# EAGLE schematic Resistor_Resistor (EAGLE 8.3.0), part 24 of 43
## Parts (continued)
R32958  10K  RESISTOR_0201  [0201]
R32959  10K  RESISTOR_0201  [0201]
R32960  10K  RESISTOR_0201  [0201]
R32961  10K  RESISTOR_0201  [0201]
R32962  10K  RESISTOR_0201  [0201]
R32963  10K  RESISTOR_0201  [0201]
R32964  10K  RESISTOR_0201  [0201]
R32965  10K  RESISTOR_0201  [0201]
R32966  10K  RESISTOR_0201  [0201]
R32967  10K  RESISTOR_0201  [0201]
R32968  10K  RESISTOR_0201  [0201]
R32969  10K  RESISTOR_0201  [0201]
R32970  10K  RESISTOR_0201  [0201]
R32971  10K  RESISTOR_0201  [0201]
R32972  10K  RESISTOR_0201  [0201]
R32973  10K  RESISTOR_0201  [0201]
R32974  10K  RESISTOR_0201  [0201]
R32975  10K  RESISTOR_0201  [0201]
R32976  10K  RESISTOR_0201  [0201]
R32977  10K  RESISTOR_0201  [0201]
R32978  10K  RESISTOR_0201  [0201]
R32979  10K  RESISTOR_0201  [0201]
R32980  10K  RESISTOR_0201  [0201]
R32981  10K  RESISTOR_0201  [0201]
R32982  10K  RESISTOR_0201  [0201]
R32983  10K  RESISTOR_0201  [0201]
R32984  10K  RESISTOR_0201  [0201]
R32985  10K  RESISTOR_0201  [0201]
R32986  10K  RESISTOR_0201  [0201]
R32987  10K  RESISTOR_0201  [0201]
R32988  10K  RESISTOR_0201  [0201]
R32989  10K  RESISTOR_0201  [0201]
R32990  10K  RESISTOR_0201  [0201]
R32991  10K  RESISTOR_0201  [0201]
R32992  10K  RESISTOR_0201  [0201]
R32993  10K  RESISTOR_0201  [0201]
R32994  10K  RESISTOR_0201  [0201]
R32995  10K  RESISTOR_0201  [0201]
R32996  10K  RESISTOR_0201  [0201]
R32997  10K  RESISTOR_0201  [0201]
R32998  10K  RESISTOR_0201  [0201]
R32999  10K  RESISTOR_0201  [0201]
R33000  10K  RESISTOR_0201  [0201]
R33001  10K  RESISTOR_0201  [0201]
R33002  10K  RESISTOR_0201  [0201]
R33003  10K  RESISTOR_0201  [0201]
R33004  10K  RESISTOR_0201  [0201]
R33005  10K  RESISTOR_0201  [0201]
R33006  10K  RESISTOR_0201  [0201]
R33007  10K  RESISTOR_0201  [0201]
R33008  10K  RESISTOR_0201  [0201]
R33009  10K  RESISTOR_0201  [0201]
R33010  10K  RESISTOR_0201  [0201]
R33011  10K  RESISTOR_0201  [0201]
R33012  10K  RESISTOR_0201  [0201]
R33013  10K  RESISTOR_0201  [0201]
R33014  10K  RESISTOR_0201  [0201]
R33015  10K  RESISTOR_0201  [0201]
R33016  10K  RESISTOR_0201  [0201]
R33017  10K  RESISTOR_0201  [0201]
R33018  10K  RESISTOR_0201  [0201]
R33019  10K  RESISTOR_0201  [0201]
R33020  10K  RESISTOR_0201  [0201]
R33021  10K  RESISTOR_0201  [0201]
R33022  10K  RESISTOR_0201  [0201]
R33023  10K  RESISTOR_0201  [0201]
R33024  10K  RESISTOR_0201  [0201]
R33025  10K  RESISTOR_0201  [0201]
R33026  10K  RESISTOR_0201  [0201]
R33027  10K  RESISTOR_0201  [0201]
R33028  10K  RESISTOR_0201  [0201]
R33029  10K  RESISTOR_0201  [0201]
R33030  10K  RESISTOR_0201  [0201]
R33031  10K  RESISTOR_0201  [0201]
R33032  10K  RESISTOR_0201  [0201]
R33033  10K  RESISTOR_0201  [0201]
R33034  10K  RESISTOR_0201  [0201]
R33035  10K  RESISTOR_0201  [0201]
R33036  10K  RESISTOR_0201  [0201]
R33037  10K  RESISTOR_0201  [0201]
R33038  10K  RESISTOR_0201  [0201]
R33039  10K  RESISTOR_0201  [0201]
R33040  10K  RESISTOR_0201  [0201]
R33041  10K  RESISTOR_0201  [0201]
R33042  10K  RESISTOR_0201  [0201]
R33043  10K  RESISTOR_0201  [0201]
R33044  10K  RESISTOR_0201  [0201]
R33045  10K  RESISTOR_0201  [0201]
R33046  10K  RESISTOR_0201  [0201]
R33047  10K  RESISTOR_0201  [0201]
R33048  10K  RESISTOR_0201  [0201]
R33049  10K  RESISTOR_0201  [0201]
R33050  10K  RESISTOR_0201  [0201]
R33051  10K  RESISTOR_0201  [0201]
R33052  10K  RESISTOR_0201  [0201]
R33053  10K  RESISTOR_0201  [0201]
R33054  10K  RESISTOR_0201  [0201]
R33055  10K  RESISTOR_0201  [0201]
R33056  10K  RESISTOR_0201  [0201]
R33057  10K  RESISTOR_0201  [0201]
R33058  10K  RESISTOR_0201  [0201]
R33059  10K  RESISTOR_0201  [0201]
R33060  10K  RESISTOR_0201  [0201]
R33061  10K  RESISTOR_0201  [0201]
R33062  10K  RESISTOR_0201  [0201]
R33063  10K  RESISTOR_0201  [0201]
R33064  10K  RESISTOR_0201  [0201]
R33065  10K  RESISTOR_0201  [0201]
R33066  10K  RESISTOR_0201  [0201]
R33067  10K  RESISTOR_0201  [0201]
R33068  10K  RESISTOR_0201  [0201]
R33069  10K  RESISTOR_0201  [0201]
R33070  10K  RESISTOR_0201  [0201]
R33071  10K  RESISTOR_0201  [0201]
R33072  10K  RESISTOR_0201  [0201]
R33073  10K  RESISTOR_0201  [0201]
R33074  10K  RESISTOR_0201  [0201]
R33075  10K  RESISTOR_0201  [0201]
R33076  10K  RESISTOR_0201  [0201]
R33077  10K  RESISTOR_0201  [0201]
R33078  10K  RESISTOR_0201  [0201]
R33079  10K  RESISTOR_0201  [0201]
R33080  10K  RESISTOR_0201  [0201]
R33081  10K  RESISTOR_0201  [0201]
R33082  10K  RESISTOR_0201  [0201]
R33083  10K  RESISTOR_0201  [0201]
R33084  10K  RESISTOR_0201  [0201]
R33085  10K  RESISTOR_0201  [0201]
R33086  10K  RESISTOR_0201  [0201]
R33087  10K  RESISTOR_0201  [0201]
R33088  10K  RESISTOR_0201  [0201]
R33089  10K  RESISTOR_0201  [0201]
R33090  10K  RESISTOR_0201  [0201]
R33091  10K  RESISTOR_0201  [0201]
R33092  10K  RESISTOR_0201  [0201]
R33093  10K  RESISTOR_0201  [0201]
R33094  10K  RESISTOR_0201  [0201]
R33095  10K  RESISTOR_0201  [0201]
R33096  10K  RESISTOR_0201  [0201]
R33097  10K  RESISTOR_0201  [0201]
R33098  10K  RESISTOR_0201  [0201]
R33099  10K  RESISTOR_0201  [0201]
R33100  10K  RESISTOR_0201  [0201]
R33101  10K  RESISTOR_0201  [0201]
R33102  10K  RESISTOR_0201  [0201]
R33103  10K  RESISTOR_0201  [0201]
R33104  10K  RESISTOR_0201  [0201]
R33105  10K  RESISTOR_0201  [0201]
R33106  10K  RESISTOR_0201  [0201]
R33107  10K  RESISTOR_0201  [0201]
R33108  10K  RESISTOR_0201  [0201]
R33109  10K  RESISTOR_0201  [0201]
R33110  10K  RESISTOR_0201  [0201]
R33111  10K  RESISTOR_0201  [0201]
R33112  10K  RESISTOR_0201  [0201]
R33113  10K  RESISTOR_0201  [0201]
R33114  10K  RESISTOR_0201  [0201]
R33115  10K  RESISTOR_0201  [0201]
R33116  10K  RESISTOR_0201  [0201]
R33117  10K  RESISTOR_0201  [0201]
R33118  10K  RESISTOR_0201  [0201]
R33119  10K  RESISTOR_0201  [0201]
R33120  10K  RESISTOR_0201  [0201]
R33121  10K  RESISTOR_0201  [0201]
R33122  10K  RESISTOR_0201  [0201]
R33123  10K  RESISTOR_0201  [0201]
R33124  10K  RESISTOR_0201  [0201]
R33125  10K  RESISTOR_0201  [0201]
R33126  10K  RESISTOR_0201  [0201]
R33127  10K  RESISTOR_0201  [0201]
R33128  10K  RESISTOR_0201  [0201]
R33129  10K  RESISTOR_0201  [0201]
R33130  10K  RESISTOR_0201  [0201]
R33131  10K  RESISTOR_0201  [0201]
R33132  10K  RESISTOR_0201  [0201]
R33133  10K  RESISTOR_0201  [0201]
R33134  10K  RESISTOR_0201  [0201]
R33135  10K  RESISTOR_0201  [0201]
R33136  10K  RESISTOR_0201  [0201]
R33137  10K  RESISTOR_0201  [0201]
R33138  10K  RESISTOR_0201  [0201]
R33139  10K  RESISTOR_0201  [0201]
R33140  10K  RESISTOR_0201  [0201]
R33141  10K  RESISTOR_0201  [0201]
R33142  10K  RESISTOR_0201  [0201]
R33143  10K  RESISTOR_0201  [0201]
R33144  10K  RESISTOR_0201  [0201]
R33145  10K  RESISTOR_0201  [0201]
R33146  10K  RESISTOR_0201  [0201]
R33147  10K  RESISTOR_0201  [0201]
R33148  10K  RESISTOR_0201  [0201]
R33149  10K  RESISTOR_0201  [0201]
R33150  10K  RESISTOR_0201  [0201]
R33151  10K  RESISTOR_0201  [0201]
R33152  10K  RESISTOR_0201  [0201]
R33153  10K  RESISTOR_0201  [0201]
R33154  10K  RESISTOR_0201  [0201]
R33155  10K  RESISTOR_0201  [0201]
R33156  10K  RESISTOR_0201  [0201]
R33157  10K  RESISTOR_0201  [0201]
R33158  10K  RESISTOR_0201  [0201]
R33159  10K  RESISTOR_0201  [0201]
R33160  10K  RESISTOR_0201  [0201]
R33161  10K  RESISTOR_0201  [0201]
R33162  10K  RESISTOR_0201  [0201]
R33163  10K  RESISTOR_0201  [0201]
R33164  10K  RESISTOR_0201  [0201]
R33165  10K  RESISTOR_0201  [0201]
R33166  10K  RESISTOR_0201  [0201]
R33167  10K  RESISTOR_0201  [0201]
R33168  10K  RESISTOR_0201  [0201]
R33169  10K  RESISTOR_0201  [0201]
R33170  10K  RESISTOR_0201  [0201]
R33171  10K  RESISTOR_0201  [0201]
R33172  10K  RESISTOR_0201  [0201]
R33173  10K  RESISTOR_0201  [0201]
R33174  10K  RESISTOR_0201  [0201]
R33175  10K  RESISTOR_0201  [0201]
R33176  10K  RESISTOR_0201  [0201]
R33177  10K  RESISTOR_0201  [0201]
R33178  10K  RESISTOR_0201  [0201]
R33179  10K  RESISTOR_0201  [0201]
R33180  10K  RESISTOR_0201  [0201]
R33181  10K  RESISTOR_0201  [0201]
R33182  10K  RESISTOR_0201  [0201]
R33183  10K  RESISTOR_0201  [0201]
R33184  10K  RESISTOR_0201  [0201]
R33185  10K  RESISTOR_0201  [0201]
R33186  10K  RESISTOR_0201  [0201]
R33187  10K  RESISTOR_0201  [0201]
R33188  10K  RESISTOR_0201  [0201]
R33189  10K  RESISTOR_0201  [0201]
R33190  10K  RESISTOR_0201  [0201]
R33191  10K  RESISTOR_0201  [0201]
R33192  10K  RESISTOR_0201  [0201]
R33193  10K  RESISTOR_0201  [0201]
R33194  10K  RESISTOR_0201  [0201]
R33195  10K  RESISTOR_0201  [0201]
R33196  10K  RESISTOR_0201  [0201]
R33197  10K  RESISTOR_0201  [0201]
R33198  10K  RESISTOR_0201  [0201]
R33199  10K  RESISTOR_0201  [0201]
R33200  10K  RESISTOR_0201  [0201]
R33201  10K  RESISTOR_0201  [0201]
R33202  10K  RESISTOR_0201  [0201]
R33203  10K  RESISTOR_0201  [0201]
R33204  10K  RESISTOR_0201  [0201]
R33205  10K  RESISTOR_0201  [0201]
R33206  10K  RESISTOR_0201  [0201]
R33207  10K  RESISTOR_0201  [0201]
R33208  10K  RESISTOR_0201  [0201]
R33209  10K  RESISTOR_0201  [0201]
R33210  10K  RESISTOR_0201  [0201]
R33211  10K  RESISTOR_0201  [0201]
R33212  10K  RESISTOR_0201  [0201]
R33213  10K  RESISTOR_0201  [0201]
R33214  10K  RESISTOR_0201  [0201]
R33215  10K  RESISTOR_0201  [0201]
R33216  10K  RESISTOR_0201  [0201]
R33217  10K  RESISTOR_0201  [0201]
R33218  10K  RESISTOR_0201  [0201]
R33219  10K  RESISTOR_0201  [0201]
R33220  10K  RESISTOR_0201  [0201]
R33221  10K  RESISTOR_0201  [0201]
R33222  10K  RESISTOR_0201  [0201]
R33223  10K  RESISTOR_0201  [0201]
R33224  10K  RESISTOR_0201  [0201]
R33225  10K  RESISTOR_0201  [0201]
R33226  10K  RESISTOR_0201  [0201]
R33227  10K  RESISTOR_0201  [0201]
R33228  10K  RESISTOR_0201  [0201]
R33229  10K  RESISTOR_0201  [0201]
R33230  10K  RESISTOR_0201  [0201]
R33231  10K  RESISTOR_0201  [0201]
R33232  10K  RESISTOR_0201  [0201]
R33233  10K  RESISTOR_0201  [0201]
R33234  10K  RESISTOR_0201  [0201]
R33235  10K  RESISTOR_0201  [0201]
R33236  10K  RESISTOR_0201  [0201]
R33237  10K  RESISTOR_0201  [0201]
R33238  10K  RESISTOR_0201  [0201]
R33239  10K  RESISTOR_0201  [0201]
R33240  10K  RESISTOR_0201  [0201]
R33241  10K  RESISTOR_0201  [0201]
R33242  10K  RESISTOR_0201  [0201]
R33243  10K  RESISTOR_0201  [0201]
R33244  10K  RESISTOR_0201  [0201]
R33245  10K  RESISTOR_0201  [0201]
R33246  10K  RESISTOR_0201  [0201]
R33247  10K  RESISTOR_0201  [0201]
R33248  10K  RESISTOR_0201  [0201]
R33249  10K  RESISTOR_0201  [0201]
R33250  10K  RESISTOR_0201  [0201]
R33251  10K  RESISTOR_0201  [0201]
R33252  10K  RESISTOR_0201  [0201]
R33253  10K  RESISTOR_0201  [0201]
R33254  10K  RESISTOR_0201  [0201]
R33255  10K  RESISTOR_0201  [0201]
R33256  10K  RESISTOR_0201  [0201]
R33257  10K  RESISTOR_0201  [0201]
R33258  10K  RESISTOR_0201  [0201]
R33259  10K  RESISTOR_0201  [0201]
R33260  10K  RESISTOR_0201  [0201]
R33261  10K  RESISTOR_0201  [0201]
R33262  10K  RESISTOR_0201  [0201]
R33263  10K  RESISTOR_0201  [0201]
R33264  10K  RESISTOR_0201  [0201]
R33265  10K  RESISTOR_0201  [0201]
R33266  10K  RESISTOR_0201  [0201]
R33267  10K  RESISTOR_0201  [0201]
R33268  10K  RESISTOR_0201  [0201]
R33269  10K  RESISTOR_0201  [0201]
R33270  10K  RESISTOR_0201  [0201]
R33271  10K  RESISTOR_0201  [0201]
R33272  10K  RESISTOR_0201  [0201]
R33273  10K  RESISTOR_0201  [0201]
R33274  10K  RESISTOR_0201  [0201]
R33275  10K  RESISTOR_0201  [0201]
R33276  10K  RESISTOR_0201  [0201]
R33277  10K  RESISTOR_0201  [0201]
R33278  10K  RESISTOR_0201  [0201]
R33279  10K  RESISTOR_0201  [0201]
R33280  10K  RESISTOR_0201  [0201]
R33281  10K  RESISTOR_0201  [0201]
R33282  10K  RESISTOR_0201  [0201]
R33283  10K  RESISTOR_0201  [0201]
R33284  10K  RESISTOR_0201  [0201]
R33285  10K  RESISTOR_0201  [0201]
R33286  10K  RESISTOR_0201  [0201]
R33287  10K  RESISTOR_0201  [0201]
R33288  10K  RESISTOR_0201  [0201]
R33289  10K  RESISTOR_0201  [0201]
R33290  10K  RESISTOR_0201  [0201]
R33291  10K  RESISTOR_0201  [0201]
R33292  10K  RESISTOR_0201  [0201]
R33293  10K  RESISTOR_0201  [0201]
R33294  10K  RESISTOR_0201  [0201]
R33295  10K  RESISTOR_0201  [0201]
R33296  10K  RESISTOR_0201  [0201]
R33297  10K  RESISTOR_0201  [0201]
R33298  10K  RESISTOR_0201  [0201]
R33299  10K  RESISTOR_0201  [0201]
R33300  10K  RESISTOR_0201  [0201]
R33301  10K  RESISTOR_0201  [0201]
R33302  10K  RESISTOR_0201  [0201]
R33303  10K  RESISTOR_0201  [0201]
R33304  10K  RESISTOR_0201  [0201]
R33305  10K  RESISTOR_0201  [0201]
R33306  10K  RESISTOR_0201  [0201]
R33307  10K  RESISTOR_0201  [0201]
R33308  10K  RESISTOR_0201  [0201]
R33309  10K  RESISTOR_0201  [0201]
R33310  10K  RESISTOR_0201  [0201]
R33311  10K  RESISTOR_0201  [0201]
R33312  10K  RESISTOR_0201  [0201]
R33313  10K  RESISTOR_0201  [0201]
R33314  10K  RESISTOR_0201  [0201]
R33315  10K  RESISTOR_0201  [0201]
R33316  10K  RESISTOR_0201  [0201]
R33317  10K  RESISTOR_0201  [0201]
R33318  10K  RESISTOR_0201  [0201]
R33319  10K  RESISTOR_0201  [0201]
R33320  10K  RESISTOR_0201  [0201]
R33321  10K  RESISTOR_0201  [0201]
R33322  10K  RESISTOR_0201  [0201]
R33323  10K  RESISTOR_0201  [0201]
R33324  10K  RESISTOR_0201  [0201]
R33325  10K  RESISTOR_0201  [0201]
R33326  10K  RESISTOR_0201  [0201]
R33327  10K  RESISTOR_0201  [0201]
R33328  10K  RESISTOR_0201  [0201]
R33329  10K  RESISTOR_0201  [0201]
R33330  10K  RESISTOR_0201  [0201]
R33331  10K  RESISTOR_0201  [0201]
R33332  10K  RESISTOR_0201  [0201]
R33333  10K  RESISTOR_0201  [0201]
R33334  10K  RESISTOR_0201  [0201]
R33335  10K  RESISTOR_0201  [0201]
R33336  10K  RESISTOR_0201  [0201]
R33337  10K  RESISTOR_0201  [0201]
R33338  10K  RESISTOR_0201  [0201]
R33339  10K  RESISTOR_0201  [0201]
R33340  10K  RESISTOR_0201  [0201]
R33341  10K  RESISTOR_0201  [0201]
R33342  10K  RESISTOR_0201  [0201]
R33343  10K  RESISTOR_0201  [0201]
R33344  10K  RESISTOR_0201  [0201]
R33345  10K  RESISTOR_0201  [0201]
R33346  10K  RESISTOR_0201  [0201]
R33347  10K  RESISTOR_0201  [0201]
R33348  10K  RESISTOR_0201  [0201]
R33349  10K  RESISTOR_0201  [0201]
R33350  10K  RESISTOR_0201  [0201]
R33351  10K  RESISTOR_0201  [0201]
R33352  10K  RESISTOR_0201  [0201]
R33353  10K  RESISTOR_0201  [0201]
R33354  10K  RESISTOR_0201  [0201]
R33355  10K  RESISTOR_0201  [0201]
R33356  10K  RESISTOR_0201  [0201]
R33357  10K  RESISTOR_0201  [0201]
R33358  10K  RESISTOR_0201  [0201]
R33359  10K  RESISTOR_0201  [0201]
R33360  10K  RESISTOR_0201  [0201]
R33361  10K  RESISTOR_0201  [0201]
R33362  10K  RESISTOR_0201  [0201]
R33363  10K  RESISTOR_0201  [0201]
R33364  10K  RESISTOR_0201  [0201]
R33365  10K  RESISTOR_0201  [0201]
R33366  10K  RESISTOR_0201  [0201]
R33367  10K  RESISTOR_0201  [0201]
R33368  10K  RESISTOR_0201  [0201]
R33369  10K  RESISTOR_0201  [0201]
R33370  10K  RESISTOR_0201  [0201]
R33371  10K  RESISTOR_0201  [0201]
R33372  10K  RESISTOR_0201  [0201]
R33373  10K  RESISTOR_0201  [0201]
R33374  10K  RESISTOR_0201  [0201]
R33375  10K  RESISTOR_0201  [0201]
R33376  10K  RESISTOR_0201  [0201]
R33377  10K  RESISTOR_0201  [0201]
R33378  10K  RESISTOR_0201  [0201]
R33379  10K  RESISTOR_0201  [0201]
R33380  10K  RESISTOR_0201  [0201]
R33381  10K  RESISTOR_0201  [0201]
R33382  10K  RESISTOR_0201  [0201]
R33383  10K  RESISTOR_0201  [0201]
R33384  10K  RESISTOR_0201  [0201]
R33385  10K  RESISTOR_0201  [0201]
R33386  10K  RESISTOR_0201  [0201]
R33387  10K  RESISTOR_0201  [0201]
R33388  10K  RESISTOR_0201  [0201]
R33389  10K  RESISTOR_0201  [0201]
R33390  10K  RESISTOR_0201  [0201]
R33391  10K  RESISTOR_0201  [0201]
R33392  10K  RESISTOR_0201  [0201]
R33393  10K  RESISTOR_0201  [0201]
R33394  10K  RESISTOR_0201  [0201]
R33395  10K  RESISTOR_0201  [0201]
R33396  10K  RESISTOR_0201  [0201]
R33397  10K  RESISTOR_0201  [0201]
R33398  10K  RESISTOR_0201  [0201]
R33399  10K  RESISTOR_0201  [0201]
R33400  10K  RESISTOR_0201  [0201]
R33401  10K  RESISTOR_0201  [0201]
R33402  10K  RESISTOR_0201  [0201]
R33403  10K  RESISTOR_0201  [0201]
R33404  10K  RESISTOR_0201  [0201]
R33405  10K  RESISTOR_0201  [0201]
R33406  10K  RESISTOR_0201  [0201]
R33407  10K  RESISTOR_0201  [0201]
R33408  10K  RESISTOR_0201  [0201]
R33409  10K  RESISTOR_0201  [0201]
R33410  10K  RESISTOR_0201  [0201]
R33411  10K  RESISTOR_0201  [0201]
R33412  10K  RESISTOR_0201  [0201]
R33413  10K  RESISTOR_0201  [0201]
R33414  10K  RESISTOR_0201  [0201]
R33415  10K  RESISTOR_0201  [0201]
R33416  10K  RESISTOR_0201  [0201]
R33417  10K  RESISTOR_0201  [0201]
R33418  10K  RESISTOR_0201  [0201]
R33419  10K  RESISTOR_0201  [0201]
R33420  10K  RESISTOR_0201  [0201]
R33421  10K  RESISTOR_0201  [0201]
R33422  10K  RESISTOR_0201  [0201]
R33423  10K  RESISTOR_0201  [0201]
R33424  10K  RESISTOR_0201  [0201]
R33425  10K  RESISTOR_0201  [0201]
R33426  10K  RESISTOR_0201  [0201]
R33427  10K  RESISTOR_0201  [0201]
R33428  10K  RESISTOR_0201  [0201]
R33429  10K  RESISTOR_0201  [0201]
R33430  10K  RESISTOR_0201  [0201]
R33431  10K  RESISTOR_0201  [0201]
R33432  10K  RESISTOR_0201  [0201]
R33433  10K  RESISTOR_0201  [0201]
R33434  10K  RESISTOR_0201  [0201]
R33435  10K  RESISTOR_0201  [0201]
R33436  10K  RESISTOR_0201  [0201]
R33437  10K  RESISTOR_0201  [0201]
R33438  10K  RESISTOR_0201  [0201]
R33439  10K  RESISTOR_0201  [0201]
R33440  10K  RESISTOR_0201  [0201]
R33441  10K  RESISTOR_0201  [0201]
R33442  10K  RESISTOR_0201  [0201]
R33443  10K  RESISTOR_0201  [0201]
R33444  10K  RESISTOR_0201  [0201]
R33445  10K  RESISTOR_0201  [0201]
R33446  10K  RESISTOR_0201  [0201]
R33447  10K  RESISTOR_0201  [0201]
R33448  10K  RESISTOR_0201  [0201]
R33449  10K  RESISTOR_0201  [0201]
R33450  10K  RESISTOR_0201  [0201]
R33451  10K  RESISTOR_0201  [0201]
R33452  10K  RESISTOR_0201  [0201]
R33453  10K  RESISTOR_0201  [0201]
R33454  10K  RESISTOR_0201  [0201]
R33455  10K  RESISTOR_0201  [0201]
R33456  10K  RESISTOR_0201  [0201]
R33457  10K  RESISTOR_0201  [0201]
R33458  10K  RESISTOR_0201  [0201]
R33459  10K  RESISTOR_0201  [0201]
R33460  10K  RESISTOR_0201  [0201]
R33461  10K  RESISTOR_0201  [0201]
R33462  10K  RESISTOR_0201  [0201]
R33463  10K  RESISTOR_0201  [0201]
R33464  10K  RESISTOR_0201  [0201]
R33465  10K  RESISTOR_0201  [0201]
R33466  10K  RESISTOR_0201  [0201]
R33467  10K  RESISTOR_0201  [0201]
R33468  10K  RESISTOR_0201  [0201]
R33469  10K  RESISTOR_0201  [0201]
R33470  10K  RESISTOR_0201  [0201]
R33471  10K  RESISTOR_0201  [0201]
R33472  10K  RESISTOR_0201  [0201]
R33473  10K  RESISTOR_0201  [0201]
R33474  10K  RESISTOR_0201  [0201]
R33475  10K  RESISTOR_0201  [0201]
R33476  10K  RESISTOR_0201  [0201]
R33477  10K  RESISTOR_0201  [0201]
R33478  10K  RESISTOR_0201  [0201]
R33479  10K  RESISTOR_0201  [0201]
R33480  10K  RESISTOR_0201  [0201]
R33481  10K  RESISTOR_0201  [0201]
R33482  10K  RESISTOR_0201  [0201]
R33483  10K  RESISTOR_0201  [0201]
R33484  10K  RESISTOR_0201  [0201]
R33485  10K  RESISTOR_0201  [0201]
R33486  10K  RESISTOR_0201  [0201]
R33487  10K  RESISTOR_0201  [0201]
R33488  10K  RESISTOR_0201  [0201]
R33489  10K  RESISTOR_0201  [0201]
R33490  10K  RESISTOR_0201  [0201]
R33491  10K  RESISTOR_0201  [0201]
R33492  10K  RESISTOR_0201  [0201]
R33493  10K  RESISTOR_0201  [0201]
R33494  10K  RESISTOR_0201  [0201]
R33495  10K  RESISTOR_0201  [0201]
R33496  10K  RESISTOR_0201  [0201]
R33497  10K  RESISTOR_0201  [0201]
R33498  10K  RESISTOR_0201  [0201]
R33499  10K  RESISTOR_0201  [0201]
R33500  10K  RESISTOR_0201  [0201]
R33501  10K  RESISTOR_0201  [0201]
R33502  10K  RESISTOR_0201  [0201]
R33503  10K  RESISTOR_0201  [0201]
R33504  10K  RESISTOR_0201  [0201]
R33505  10K  RESISTOR_0201  [0201]
R33506  10K  RESISTOR_0201  [0201]
R33507  10K  RESISTOR_0201  [0201]
R33508  10K  RESISTOR_0201  [0201]
R33509  10K  RESISTOR_0201  [0201]
R33510  10K  RESISTOR_0201  [0201]
R33511  10K  RESISTOR_0201  [0201]
R33512  10K  RESISTOR_0201  [0201]
R33513  10K  RESISTOR_0201  [0201]
R33514  10K  RESISTOR_0201  [0201]
R33515  10K  RESISTOR_0201  [0201]
R33516  10K  RESISTOR_0201  [0201]
R33517  10K  RESISTOR_0201  [0201]
R33518  10K  RESISTOR_0201  [0201]
R33519  10K  RESISTOR_0201  [0201]
R33520  10K  RESISTOR_0201  [0201]
R33521  10K  RESISTOR_0201  [0201]
R33522  10K  RESISTOR_0201  [0201]
R33523  10K  RESISTOR_0201  [0201]
R33524  10K  RESISTOR_0201  [0201]
R33525  10K  RESISTOR_0201  [0201]
R33526  10K  RESISTOR_0201  [0201]
R33527  10K  RESISTOR_0201  [0201]
R33528  10K  RESISTOR_0201  [0201]
R33529  10K  RESISTOR_0201  [0201]
R33530  10K  RESISTOR_0201  [0201]
R33531  10K  RESISTOR_0201  [0201]
R33532  10K  RESISTOR_0201  [0201]
R33533  10K  RESISTOR_0201  [0201]
R33534  10K  RESISTOR_0201  [0201]
R33535  10K  RESISTOR_0201  [0201]
R33536  10K  RESISTOR_0201  [0201]
R33537  10K  RESISTOR_0201  [0201]
R33538  10K  RESISTOR_0201  [0201]
R33539  10K  RESISTOR_0201  [0201]
R33540  10K  RESISTOR_0201  [0201]
R33541  10K  RESISTOR_0201  [0201]
R33542  10K  RESISTOR_0201  [0201]
R33543  10K  RESISTOR_0201  [0201]
R33544  10K  RESISTOR_0201  [0201]
R33545  10K  RESISTOR_0201  [0201]
R33546  10K  RESISTOR_0201  [0201]
R33547  10K  RESISTOR_0201  [0201]
R33548  10K  RESISTOR_0201  [0201]
R33549  10K  RESISTOR_0201  [0201]
R33550  10K  RESISTOR_0201  [0201]
R33551  10K  RESISTOR_0201  [0201]
R33552  10K  RESISTOR_0201  [0201]
R33553  10K  RESISTOR_0201  [0201]
R33554  10K  RESISTOR_0201  [0201]
R33555  10K  RESISTOR_0201  [0201]
R33556  10K  RESISTOR_0201  [0201]
R33557  10K  RESISTOR_0201  [0201]
R33558  10K  RESISTOR_0201  [0201]
R33559  10K  RESISTOR_0201  [0201]
R33560  10K  RESISTOR_0201  [0201]
R33561  10K  RESISTOR_0201  [0201]
R33562  10K  RESISTOR_0201  [0201]
R33563  10K  RESISTOR_0201  [0201]
R33564  10K  RESISTOR_0201  [0201]
R33565  10K  RESISTOR_0201  [0201]
R33566  10K  RESISTOR_0201  [0201]
R33567  10K  RESISTOR_0201  [0201]
R33568  10K  RESISTOR_0201  [0201]
R33569  10K  RESISTOR_0201  [0201]
R33570  10K  RESISTOR_0201  [0201]
R33571  10K  RESISTOR_0201  [0201]
R33572  10K  RESISTOR_0201  [0201]
R33573  10K  RESISTOR_0201  [0201]
R33574  10K  RESISTOR_0201  [0201]
R33575  10K  RESISTOR_0201  [0201]
R33576  10K  RESISTOR_0201  [0201]
R33577  10K  RESISTOR_0201  [0201]
R33578  10K  RESISTOR_0201  [0201]
R33579  10K  RESISTOR_0201  [0201]
R33580  10K  RESISTOR_0201  [0201]
R33581  10K  RESISTOR_0201  [0201]
R33582  10K  RESISTOR_0201  [0201]
R33583  10K  RESISTOR_0201  [0201]
R33584  10K  RESISTOR_0201  [0201]
R33585  10K  RESISTOR_0201  [0201]
R33586  10K  RESISTOR_0201  [0201]
R33587  10K  RESISTOR_0201  [0201]
R33588  10K  RESISTOR_0201  [0201]
R33589  10K  RESISTOR_0201  [0201]
R33590  10K  RESISTOR_0201  [0201]
R33591  10K  RESISTOR_0201  [0201]
R33592  10K  RESISTOR_0201  [0201]
R33593  10K  RESISTOR_0201  [0201]
R33594  10K  RESISTOR_0201  [0201]
R33595  10K  RESISTOR_0201  [0201]
R33596  10K  RESISTOR_0201  [0201]
R33597  10K  RESISTOR_0201  [0201]
R33598  10K  RESISTOR_0201  [0201]
R33599  10K  RESISTOR_0201  [0201]
R33600  10K  RESISTOR_0201  [0201]
R33601  10K  RESISTOR_0201  [0201]
R33602  10K  RESISTOR_0201  [0201]
R33603  10K  RESISTOR_0201  [0201]
R33604  10K  RESISTOR_0201  [0201]
R33605  10K  RESISTOR_0201  [0201]
R33606  10K  RESISTOR_0201  [0201]
R33607  10K  RESISTOR_0201  [0201]
R33608  10K  RESISTOR_0201  [0201]
R33609  10K  RESISTOR_0201  [0201]
R33610  10K  RESISTOR_0201  [0201]
R33611  10K  RESISTOR_0201  [0201]
R33612  10K  RESISTOR_0201  [0201]
R33613  10K  RESISTOR_0201  [0201]
R33614  10K  RESISTOR_0201  [0201]
R33615  10K  RESISTOR_0201  [0201]
R33616  10K  RESISTOR_0201  [0201]
R33617  10K  RESISTOR_0201  [0201]
R33618  10K  RESISTOR_0201  [0201]
R33619  10K  RESISTOR_0201  [0201]
R33620  10K  RESISTOR_0201  [0201]
R33621  10K  RESISTOR_0201  [0201]
R33622  10K  RESISTOR_0201  [0201]
R33623  10K  RESISTOR_0201  [0201]
R33624  10K  RESISTOR_0201  [0201]
R33625  10K  RESISTOR_0201  [0201]
R33626  10K  RESISTOR_0201  [0201]
R33627  10K  RESISTOR_0201  [0201]
R33628  10K  RESISTOR_0201  [0201]
R33629  10K  RESISTOR_0201  [0201]
R33630  10K  RESISTOR_0201  [0201]
R33631  10K  RESISTOR_0201  [0201]
R33632  10K  RESISTOR_0201  [0201]
R33633  10K  RESISTOR_0201  [0201]
R33634  10K  RESISTOR_0201  [0201]
R33635  10K  RESISTOR_0201  [0201]
R33636  10K  RESISTOR_0201  [0201]
R33637  10K  RESISTOR_0201  [0201]
R33638  10K  RESISTOR_0201  [0201]
R33639  10K  RESISTOR_0201  [0201]
R33640  10K  RESISTOR_0201  [0201]
R33641  10K  RESISTOR_0201  [0201]
R33642  10K  RESISTOR_0201  [0201]
R33643  10K  RESISTOR_0201  [0201]
R33644  10K  RESISTOR_0201  [0201]
R33645  10K  RESISTOR_0201  [0201]
R33646  10K  RESISTOR_0201  [0201]
R33647  10K  RESISTOR_0201  [0201]
R33648  10K  RESISTOR_0201  [0201]
R33649  10K  RESISTOR_0201  [0201]
R33650  10K  RESISTOR_0201  [0201]
R33651  10K  RESISTOR_0201  [0201]
R33652  10K  RESISTOR_0201  [0201]
R33653  10K  RESISTOR_0201  [0201]
R33654  10K  RESISTOR_0201  [0201]
R33655  10K  RESISTOR_0201  [0201]
R33656  10K  RESISTOR_0201  [0201]
R33657  10K  RESISTOR_0201  [0201]
R33658  10K  RESISTOR_0201  [0201]
R33659  10K  RESISTOR_0201  [0201]
R33660  10K  RESISTOR_0201  [0201]
R33661  10K  RESISTOR_0201  [0201]
R33662  10K  RESISTOR_0201  [0201]
R33663  10K  RESISTOR_0201  [0201]
R33664  10K  RESISTOR_0201  [0201]
R33665  10K  RESISTOR_0201  [0201]
R33666  10K  RESISTOR_0201  [0201]
R33667  10K  RESISTOR_0201  [0201]
R33668  10K  RESISTOR_0201  [0201]
R33669  10K  RESISTOR_0201  [0201]
R33670  10K  RESISTOR_0201  [0201]
R33671  10K  RESISTOR_0201  [0201]
R33672  10K  RESISTOR_0201  [0201]
R33673  10K  RESISTOR_0201  [0201]
R33674  10K  RESISTOR_0201  [0201]
R33675  10K  RESISTOR_0201  [0201]
R33676  10K  RESISTOR_0201  [0201]
R33677  10K  RESISTOR_0201  [0201]
R33678  10K  RESISTOR_0201  [0201]
R33679  10K  RESISTOR_0201  [0201]
R33680  10K  RESISTOR_0201  [0201]
R33681  10K  RESISTOR_0201  [0201]
R33682  10K  RESISTOR_0201  [0201]
R33683  10K  RESISTOR_0201  [0201]
R33684  10K  RESISTOR_0201  [0201]
R33685  10K  RESISTOR_0201  [0201]
R33686  10K  RESISTOR_0201  [0201]
R33687  10K  RESISTOR_0201  [0201]
R33688  10K  RESISTOR_0201  [0201]
R33689  10K  RESISTOR_0201  [0201]
R33690  10K  RESISTOR_0201  [0201]
R33691  10K  RESISTOR_0201  [0201]
R33692  10K  RESISTOR_0201  [0201]
R33693  10K  RESISTOR_0201  [0201]
R33694  10K  RESISTOR_0201  [0201]
R33695  10K  RESISTOR_0201  [0201]
R33696  10K  RESISTOR_0201  [0201]
R33697  10K  RESISTOR_0201  [0201]
R33698  10K  RESISTOR_0201  [0201]
R33699  10K  RESISTOR_0201  [0201]
R33700  10K  RESISTOR_0201  [0201]
R33701  10K  RESISTOR_0201  [0201]
R33702  10K  RESISTOR_0201  [0201]
R33703  10K  RESISTOR_0201  [0201]
R33704  10K  RESISTOR_0201  [0201]
R33705  10K  RESISTOR_0201  [0201]
R33706  10K  RESISTOR_0201  [0201]
R33707  10K  RESISTOR_0201  [0201]
R33708  10K  RESISTOR_0201  [0201]
R33709  10K  RESISTOR_0201  [0201]
R33710  10K  RESISTOR_0201  [0201]
R33711  10K  RESISTOR_0201  [0201]
R33712  10K  RESISTOR_0201  [0201]
R33713  10K  RESISTOR_0201  [0201]
R33714  10K  RESISTOR_0201  [0201]
R33715  10K  RESISTOR_0201  [0201]
R33716  10K  RESISTOR_0201  [0201]
R33717  10K  RESISTOR_0201  [0201]
R33718  10K  RESISTOR_0201  [0201]
R33719  10K  RESISTOR_0201  [0201]
R33720  10K  RESISTOR_0201  [0201]
R33721  10K  RESISTOR_0201  [0201]
R33722  10K  RESISTOR_0201  [0201]
R33723  10K  RESISTOR_0201  [0201]
R33724  10K  RESISTOR_0201  [0201]
R33725  10K  RESISTOR_0201  [0201]
R33726  10K  RESISTOR_0201  [0201]
R33727  10K  RESISTOR_0201  [0201]
R33728  10K  RESISTOR_0201  [0201]
R33729  10K  RESISTOR_0201  [0201]
R33730  10K  RESISTOR_0201  [0201]
R33731  10K  RESISTOR_0201  [0201]
R33732  10K  RESISTOR_0201  [0201]
R33733  10K  RESISTOR_0201  [0201]
R33734  10K  RESISTOR_0201  [0201]
R33735  10K  RESISTOR_0201  [0201]
R33736  10K  RESISTOR_0201  [0201]
R33737  10K  RESISTOR_0201  [0201]
R33738  10K  RESISTOR_0201  [0201]
R33739  10K  RESISTOR_0201  [0201]
R33740  10K  RESISTOR_0201  [0201]
R33741  10K  RESISTOR_0201  [0201]
R33742  10K  RESISTOR_0201  [0201]
R33743  10K  RESISTOR_0201  [0201]
R33744  10K  RESISTOR_0201  [0201]
R33745  10K  RESISTOR_0201  [0201]
R33746  10K  RESISTOR_0201  [0201]
R33747  10K  RESISTOR_0201  [0201]
R33748  10K  RESISTOR_0201  [0201]
R33749  10K  RESISTOR_0201  [0201]
R33750  10K  RESISTOR_0201  [0201]
R33751  10K  RESISTOR_0201  [0201]
R33752  10K  RESISTOR_0201  [0201]
R33753  10K  RESISTOR_0201  [0201]
R33754  10K  RESISTOR_0201  [0201]
R33755  10K  RESISTOR_0201  [0201]
R33756  10K  RESISTOR_0201  [0201]
R33757  10K  RESISTOR_0201  [0201]
R33758  10K  RESISTOR_0201  [0201]
R33759  10K  RESISTOR_0201  [0201]
R33760  10K  RESISTOR_0201  [0201]
R33761  10K  RESISTOR_0201  [0201]
R33762  10K  RESISTOR_0201  [0201]
R33763  10K  RESISTOR_0201  [0201]
R33764  10K  RESISTOR_0201  [0201]
R33765  10K  RESISTOR_0201  [0201]
R33766  10K  RESISTOR_0201  [0201]
R33767  10K  RESISTOR_0201  [0201]
R33768  10K  RESISTOR_0201  [0201]
R33769  10K  RESISTOR_0201  [0201]
R33770  10K  RESISTOR_0201  [0201]
R33771  10K  RESISTOR_0201  [0201]
R33772  10K  RESISTOR_0201  [0201]
R33773  10K  RESISTOR_0201  [0201]
R33774  10K  RESISTOR_0201  [0201]
R33775  10K  RESISTOR_0201  [0201]
R33776  10K  RESISTOR_0201  [0201]
R33777  10K  RESISTOR_0201  [0201]
R33778  10K  RESISTOR_0201  [0201]
R33779  10K  RESISTOR_0201  [0201]
R33780  10K  RESISTOR_0201  [0201]
R33781  10K  RESISTOR_0201  [0201]
R33782  10K  RESISTOR_0201  [0201]
R33783  10K  RESISTOR_0201  [0201]
R33784  10K  RESISTOR_0201  [0201]
R33785  10K  RESISTOR_0201  [0201]
R33786  10K  RESISTOR_0201  [0201]
R33787  10K  RESISTOR_0201  [0201]
R33788  10K  RESISTOR_0201  [0201]
R33789  10K  RESISTOR_0201  [0201]
R33790  10K  RESISTOR_0201  [0201]
R33791  10K  RESISTOR_0201  [0201]
R33792  10K  RESISTOR_0201  [0201]
R33793  10K  RESISTOR_0201  [0201]
R33794  10K  RESISTOR_0201  [0201]
R33795  10K  RESISTOR_0201  [0201]
R33796  10K  RESISTOR_0201  [0201]
R33797  10K  RESISTOR_0201  [0201]
R33798  10K  RESISTOR_0201  [0201]
R33799  10K  RESISTOR_0201  [0201]
R33800  10K  RESISTOR_0201  [0201]
R33801  10K  RESISTOR_0201  [0201]
R33802  10K  RESISTOR_0201  [0201]
R33803  10K  RESISTOR_0201  [0201]
R33804  10K  RESISTOR_0201  [0201]
R33805  10K  RESISTOR_0201  [0201]
R33806  10K  RESISTOR_0201  [0201]
R33807  10K  RESISTOR_0201  [0201]
R33808  10K  RESISTOR_0201  [0201]
R33809  10K  RESISTOR_0201  [0201]
R33810  10K  RESISTOR_0201  [0201]
R33811  10K  RESISTOR_0201  [0201]
R33812  10K  RESISTOR_0201  [0201]
R33813  10K  RESISTOR_0201  [0201]
R33814  10K  RESISTOR_0201  [0201]
R33815  10K  RESISTOR_0201  [0201]
R33816  10K  RESISTOR_0201  [0201]
R33817  10K  RESISTOR_0201  [0201]
R33818  10K  RESISTOR_0201  [0201]
R33819  10K  RESISTOR_0201  [0201]
R33820  10K  RESISTOR_0201  [0201]
R33821  10K  RESISTOR_0201  [0201]
R33822  10K  RESISTOR_0201  [0201]
R33823  10K  RESISTOR_0201  [0201]
R33824  10K  RESISTOR_0201  [0201]
R33825  10K  RESISTOR_0201  [0201]
R33826  10K  RESISTOR_0201  [0201]
R33827  10K  RESISTOR_0201  [0201]
R33828  10K  RESISTOR_0201  [0201]
R33829  10K  RESISTOR_0201  [0201]
R33830  10K  RESISTOR_0201  [0201]
R33831  10K  RESISTOR_0201  [0201]
R33832  10K  RESISTOR_0201  [0201]
R33833  10K  RESISTOR_0201  [0201]
R33834  10K  RESISTOR_0201  [0201]
R33835  10K  RESISTOR_0201  [0201]
R33836  10K  RESISTOR_0201  [0201]
R33837  10K  RESISTOR_0201  [0201]
R33838  10K  RESISTOR_0201  [0201]
R33839  10K  RESISTOR_0201  [0201]
R33840  10K  RESISTOR_0201  [0201]
R33841  10K  RESISTOR_0201  [0201]
R33842  10K  RESISTOR_0201  [0201]
R33843  10K  RESISTOR_0201  [0201]
R33844  10K  RESISTOR_0201  [0201]
R33845  10K  RESISTOR_0201  [0201]
R33846  10K  RESISTOR_0201  [0201]
R33847  10K  RESISTOR_0201  [0201]
R33848  10K  RESISTOR_0201  [0201]
R33849  10K  RESISTOR_0201  [0201]
R33850  10K  RESISTOR_0201  [0201]
R33851  10K  RESISTOR_0201  [0201]
R33852  10K  RESISTOR_0201  [0201]
R33853  10K  RESISTOR_0201  [0201]
R33854  10K  RESISTOR_0201  [0201]
R33855  10K  RESISTOR_0201  [0201]
R33856  10K  RESISTOR_0201  [0201]
R33857  10K  RESISTOR_0201  [0201]
R33858  10K  RESISTOR_0201  [0201]
R33859  10K  RESISTOR_0201  [0201]
R33860  10K  RESISTOR_0201  [0201]
R33861  10K  RESISTOR_0201  [0201]
R33862  10K  RESISTOR_0201  [0201]
R33863  10K  RESISTOR_0201  [0201]
R33864  10K  RESISTOR_0201  [0201]
R33865  10K  RESISTOR_0201  [0201]
R33866  10K  RESISTOR_0201  [0201]
R33867  10K  RESISTOR_0201  [0201]
R33868  10K  RESISTOR_0201  [0201]
R33869  10K  RESISTOR_0201  [0201]
R33870  10K  RESISTOR_0201  [0201]
R33871  10K  RESISTOR_0201  [0201]
R33872  10K  RESISTOR_0201  [0201]
R33873  10K  RESISTOR_0201  [0201]
R33874  10K  RESISTOR_0201  [0201]
R33875  10K  RESISTOR_0201  [0201]
R33876  10K  RESISTOR_0201  [0201]
R33877  10K  RESISTOR_0201  [0201]
R33878  10K  RESISTOR_0201  [0201]
R33879  10K  RESISTOR_0201  [0201]
R33880  10K  RESISTOR_0201  [0201]
R33881  10K  RESISTOR_0201  [0201]
R33882  10K  RESISTOR_0201  [0201]
R33883  10K  RESISTOR_0201  [0201]
R33884  10K  RESISTOR_0201  [0201]
R33885  10K  RESISTOR_0201  [0201]
R33886  10K  RESISTOR_0201  [0201]
R33887  10K  RESISTOR_0201  [0201]
R33888  10K  RESISTOR_0201  [0201]
R33889  10K  RESISTOR_0201  [0201]
R33890  10K  RESISTOR_0201  [0201]
R33891  10K  RESISTOR_0201  [0201]
R33892  10K  RESISTOR_0201  [0201]
R33893  10K  RESISTOR_0201  [0201]
R33894  10K  RESISTOR_0201  [0201]
R33895  10K  RESISTOR_0201  [0201]
R33896  10K  RESISTOR_0201  [0201]
R33897  10K  RESISTOR_0201  [0201]
R33898  10K  RESISTOR_0201  [0201]
R33899  10K  RESISTOR_0201  [0201]
R33900  10K  RESISTOR_0201  [0201]
R33901  10K  RESISTOR_0201  [0201]
R33902  10K  RESISTOR_0201  [0201]
R33903  10K  RESISTOR_0201  [0201]
R33904  10K  RESISTOR_0201  [0201]
R33905  10K  RESISTOR_0201  [0201]
R33906  10K  RESISTOR_0201  [0201]
R33907  10K  RESISTOR_0201  [0201]
R33908  10K  RESISTOR_0201  [0201]
R33909  10K  RESISTOR_0201  [0201]
R33910  10K  RESISTOR_0201  [0201]
R33911  10K  RESISTOR_0201  [0201]
R33912  10K  RESISTOR_0201  [0201]
R33913  10K  RESISTOR_0201  [0201]
R33914  10K  RESISTOR_0201  [0201]
R33915  10K  RESISTOR_0201  [0201]
R33916  10K  RESISTOR_0201  [0201]
R33917  10K  RESISTOR_0201  [0201]
R33918  10K  RESISTOR_0201  [0201]
R33919  10K  RESISTOR_0201  [0201]
R33920  10K  RESISTOR_0201  [0201]
R33921  10K  RESISTOR_0201  [0201]
R33922  10K  RESISTOR_0201  [0201]
R33923  10K  RESISTOR_0201  [0201]
R33924  10K  RESISTOR_0201  [0201]
R33925  10K  RESISTOR_0201  [0201]
R33926  10K  RESISTOR_0201  [0201]
R33927  10K  RESISTOR_0201  [0201]
R33928  10K  RESISTOR_0201  [0201]
R33929  10K  RESISTOR_0201  [0201]
R33930  10K  RESISTOR_0201  [0201]
R33931  10K  RESISTOR_0201  [0201]
R33932  10K  RESISTOR_0201  [0201]
R33933  10K  RESISTOR_0201  [0201]
R33934  10K  RESISTOR_0201  [0201]
R33935  10K  RESISTOR_0201  [0201]
R33936  10K  RESISTOR_0201  [0201]
R33937  10K  RESISTOR_0201  [0201]
R33938  10K  RESISTOR_0201  [0201]
R33939  10K  RESISTOR_0201  [0201]
R33940  10K  RESISTOR_0201  [0201]
R33941  10K  RESISTOR_0201  [0201]
R33942  10K  RESISTOR_0201  [0201]
R33943  10K  RESISTOR_0201  [0201]
R33944  10K  RESISTOR_0201  [0201]
R33945  10K  RESISTOR_0201  [0201]
R33946  10K  RESISTOR_0201  [0201]
R33947  10K  RESISTOR_0201  [0201]
R33948  10K  RESISTOR_0201  [0201]
R33949  10K  RESISTOR_0201  [0201]
R33950  10K  RESISTOR_0201  [0201]
R33951  10K  RESISTOR_0201  [0201]
R33952  10K  RESISTOR_0201  [0201]
R33953  10K  RESISTOR_0201  [0201]
R33954  10K  RESISTOR_0201  [0201]
R33955  10K  RESISTOR_0201  [0201]
R33956  10K  RESISTOR_0201  [0201]
R33957  10K  RESISTOR_0201  [0201]
R33958  10K  RESISTOR_0201  [0201]
R33959  10K  RESISTOR_0201  [0201]
R33960  10K  RESISTOR_0201  [0201]
R33961  10K  RESISTOR_0201  [0201]
R33962  10K  RESISTOR_0201  [0201]
R33963  10K  RESISTOR_0201  [0201]
R33964  10K  RESISTOR_0201  [0201]
R33965  10K  RESISTOR_0201  [0201]
R33966  10K  RESISTOR_0201  [0201]
R33967  10K  RESISTOR_0201  [0201]
R33968  10K  RESISTOR_0201  [0201]
R33969  10K  RESISTOR_0201  [0201]
R33970  10K  RESISTOR_0201  [0201]
R33971  10K  RESISTOR_0201  [0201]
R33972  10K  RESISTOR_0201  [0201]
R33973  10K  RESISTOR_0201  [0201]
R33974  10K  RESISTOR_0201  [0201]
R33975  10K  RESISTOR_0201  [0201]
R33976  10K  RESISTOR_0201  [0201]
R33977  10K  RESISTOR_0201  [0201]
R33978  10K  RESISTOR_0201  [0201]
R33979  10K  RESISTOR_0201  [0201]
R33980  10K  RESISTOR_0201  [0201]
R33981  10K  RESISTOR_0201  [0201]
R33982  10K  RESISTOR_0201  [0201]
R33983  10K  RESISTOR_0201  [0201]
R33984  10K  RESISTOR_0201  [0201]
R33985  10K  RESISTOR_0201  [0201]
R33986  10K  RESISTOR_0201  [0201]
R33987  10K  RESISTOR_0201  [0201]
R33988  10K  RESISTOR_0201  [0201]
R33989  10K  RESISTOR_0201  [0201]
R33990  10K  RESISTOR_0201  [0201]
R33991  10K  RESISTOR_0201  [0201]
R33992  10K  RESISTOR_0201  [0201]
R33993  10K  RESISTOR_0201  [0201]
R33994  10K  RESISTOR_0201  [0201]
R33995  10K  RESISTOR_0201  [0201]
R33996  10K  RESISTOR_0201  [0201]
R33997  10K  RESISTOR_0201  [0201]
R33998  10K  RESISTOR_0201  [0201]
R33999  10K  RESISTOR_0201  [0201]
R34000  10K  RESISTOR_0201  [0201]
R34001  10K  RESISTOR_0201  [0201]
R34002  10K  RESISTOR_0201  [0201]
R34003  10K  RESISTOR_0201  [0201]
R34004  10K  RESISTOR_0201  [0201]
R34005  10K  RESISTOR_0201  [0201]
R34006  10K  RESISTOR_0201  [0201]
R34007  10K  RESISTOR_0201  [0201]
R34008  10K  RESISTOR_0201  [0201]
R34009  10K  RESISTOR_0201  [0201]
R34010  10K  RESISTOR_0201  [0201]
R34011  10K  RESISTOR_0201  [0201]
R34012  10K  RESISTOR_0201  [0201]
R34013  10K  RESISTOR_0201  [0201]
R34014  10K  RESISTOR_0201  [0201]
R34015  10K  RESISTOR_0201  [0201]
R34016  10K  RESISTOR_0201  [0201]
R34017  10K  RESISTOR_0201  [0201]
R34018  10K  RESISTOR_0201  [0201]
R34019  10K  RESISTOR_0201  [0201]
R34020  10K  RESISTOR_0201  [0201]
R34021  10K  RESISTOR_0201  [0201]
R34022  10K  RESISTOR_0201  [0201]
R34023  10K  RESISTOR_0201  [0201]
R34024  10K  RESISTOR_0201  [0201]
R34025  10K  RESISTOR_0201  [0201]
R34026  10K  RESISTOR_0201  [0201]
R34027  10K  RESISTOR_0201  [0201]
R34028  10K  RESISTOR_0201  [0201]
R34029  10K  RESISTOR_0201  [0201]
R34030  10K  RESISTOR_0201  [0201]
R34031  10K  RESISTOR_0201  [0201]
R34032  10K  RESISTOR_0201  [0201]
R34033  10K  RESISTOR_0201  [0201]
R34034  10K  RESISTOR_0201  [0201]
R34035  10K  RESISTOR_0201  [0201]
R34036  10K  RESISTOR_0201  [0201]
R34037  10K  RESISTOR_0201  [0201]
R34038  10K  RESISTOR_0201  [0201]
R34039  10K  RESISTOR_0201  [0201]
R34040  10K  RESISTOR_0201  [0201]
R34041  10K  RESISTOR_0201  [0201]
R34042  10K  RESISTOR_0201  [0201]
R34043  10K  RESISTOR_0201  [0201]
R34044  10K  RESISTOR_0201  [0201]
R34045  10K  RESISTOR_0201  [0201]
R34046  10K  RESISTOR_0201  [0201]
R34047  10K  RESISTOR_0201  [0201]
R34048  10K  RESISTOR_0201  [0201]
R34049  10K  RESISTOR_0201  [0201]
R34050  10K  RESISTOR_0201  [0201]
R34051  10K  RESISTOR_0201  [0201]
R34052  10K  RESISTOR_0201  [0201]
R34053  10K  RESISTOR_0201  [0201]
R34054  10K  RESISTOR_0201  [0201]
R34055  10K  RESISTOR_0201  [0201]
R34056  10K  RESISTOR_0201  [0201]
R34057  10K  RESISTOR_0201  [0201]
R34058  10K  RESISTOR_0201  [0201]
R34059  10K  RESISTOR_0201  [0201]
R34060  10K  RESISTOR_0201  [0201]
R34061  10K  RESISTOR_0201  [0201]
R34062  10K  RESISTOR_0201  [0201]
R34063  10K  RESISTOR_0201  [0201]
R34064  10K  RESISTOR_0201  [0201]
R34065  10K  RESISTOR_0201  [0201]
R34066  10K  RESISTOR_0201  [0201]
R34067  10K  RESISTOR_0201  [0201]
R34068  10K  RESISTOR_0201  [0201]
R34069  10K  RESISTOR_0201  [0201]
R34070  10K  RESISTOR_0201  [0201]
R34071  10K  RESISTOR_0201  [0201]
R34072  10K  RESISTOR_0201  [0201]
R34073  10K  RESISTOR_0201  [0201]
R34074  10K  RESISTOR_0201  [0201]
R34075  10K  RESISTOR_0201  [0201]
R34076  10K  RESISTOR_0201  [0201]
R34077  10K  RESISTOR_0201  [0201]
R34078  10K  RESISTOR_0201  [0201]
R34079  10K  RESISTOR_0201  [0201]
R34080  10K  RESISTOR_0201  [0201]
R34081  10K  RESISTOR_0201  [0201]
R34082  10K  RESISTOR_0201  [0201]
R34083  10K  RESISTOR_0201  [0201]
R34084  10K  RESISTOR_0201  [0201]
R34085  10K  RESISTOR_0201  [0201]
R34086  10K  RESISTOR_0201  [0201]
R34087  10K  RESISTOR_0201  [0201]
R34088  10K  RESISTOR_0201  [0201]
R34089  10K  RESISTOR_0201  [0201]
R34090  10K  RESISTOR_0201  [0201]
R34091  10K  RESISTOR_0201  [0201]
R34092  10K  RESISTOR_0201  [0201]
R34093  10K  RESISTOR_0201  [0201]
R34094  10K  RESISTOR_0201  [0201]
R34095  10K  RESISTOR_0201  [0201]
R34096  10K  RESISTOR_0201  [0201]
R34097  10K  RESISTOR_0201  [0201]
R34098  10K  RESISTOR_0201  [0201]
R34099  10K  RESISTOR_0201  [0201]
R34100  10K  RESISTOR_0201  [0201]
R34101  10K  RESISTOR_0201  [0201]
R34102  10K  RESISTOR_0201  [0201]
R34103  10K  RESISTOR_0201  [0201]
R34104  10K  RESISTOR_0201  [0201]
R34105  10K  RESISTOR_0201  [0201]
R34106  10K  RESISTOR_0201  [0201]
R34107  10K  RESISTOR_0201  [0201]
R34108  10K  RESISTOR_0201  [0201]
R34109  10K  RESISTOR_0201  [0201]
R34110  10K  RESISTOR_0201  [0201]
R34111  10K  RESISTOR_0201  [0201]
R34112  10K  RESISTOR_0201  [0201]
R34113  10K  RESISTOR_0201  [0201]
R34114  10K  RESISTOR_0201  [0201]
R34115  10K  RESISTOR_0201  [0201]
R34116  10K  RESISTOR_0201  [0201]
R34117  10K  RESISTOR_0201  [0201]
R34118  10K  RESISTOR_0201  [0201]
R34119  10K  RESISTOR_0201  [0201]
R34120  10K  RESISTOR_0201  [0201]
R34121  10K  RESISTOR_0201  [0201]
R34122  10K  RESISTOR_0201  [0201]
R34123  10K  RESISTOR_0201  [0201]
R34124  10K  RESISTOR_0201  [0201]
R34125  10K  RESISTOR_0201  [0201]
R34126  10K  RESISTOR_0201  [0201]
R34127  10K  RESISTOR_0201  [0201]
R34128  10K  RESISTOR_0201  [0201]
R34129  10K  RESISTOR_0201  [0201]
R34130  10K  RESISTOR_0201  [0201]
R34131  10K  RESISTOR_0201  [0201]
R34132  10K  RESISTOR_0201  [0201]
R34133  10K  RESISTOR_0201  [0201]
R34134  10K  RESISTOR_0201  [0201]
R34135  10K  RESISTOR_0201  [0201]
R34136  10K  RESISTOR_0201  [0201]
R34137  10K  RESISTOR_0201  [0201]
R34138  10K  RESISTOR_0201  [0201]
R34139  10K  RESISTOR_0201  [0201]
R34140  10K  RESISTOR_0201  [0201]
R34141  10K  RESISTOR_0201  [0201]
R34142  10K  RESISTOR_0201  [0201]
R34143  10K  RESISTOR_0201  [0201]
R34144  10K  RESISTOR_0201  [0201]
R34145  10K  RESISTOR_0201  [0201]
R34146  10K  RESISTOR_0201  [0201]
R34147  10K  RESISTOR_0201  [0201]
R34148  10K  RESISTOR_0201  [0201]
R34149  10K  RESISTOR_0201  [0201]
R34150  10K  RESISTOR_0201  [0201]
R34151  10K  RESISTOR_0201  [0201]
R34152  10K  RESISTOR_0201  [0201]
R34153  10K  RESISTOR_0201  [0201]
R34154  10K  RESISTOR_0201  [0201]
R34155  10K  RESISTOR_0201  [0201]
R34156  10K  RESISTOR_0201  [0201]
R34157  10K  RESISTOR_0201  [0201]
R34158  10K  RESISTOR_0201  [0201]
R34159  10K  RESISTOR_0201  [0201]
R34160  10K  RESISTOR_0201  [0201]
R34161  10K  RESISTOR_0201  [0201]
R34162  10K  RESISTOR_0201  [0201]
R34163  10K  RESISTOR_0201  [0201]
R34164  10K  RESISTOR_0201  [0201]
R34165  10K  RESISTOR_0201  [0201]
R34166  10K  RESISTOR_0201  [0201]
R34167  10K  RESISTOR_0201  [0201]
R34168  10K  RESISTOR_0201  [0201]
R34169  10K  RESISTOR_0201  [0201]
R34170  10K  RESISTOR_0201  [0201]
R34171  10K  RESISTOR_0201  [0201]
R34172  10K  RESISTOR_0201  [0201]
R34173  10K  RESISTOR_0201  [0201]
R34174  10K  RESISTOR_0201  [0201]
R34175  10K  RESISTOR_0201  [0201]
R34176  10K  RESISTOR_0201  [0201]
R34177  10K  RESISTOR_0201  [0201]
R34178  10K  RESISTOR_0201  [0201]
R34179  10K  RESISTOR_0201  [0201]
R34180  10K  RESISTOR_0201  [0201]
R34181  10K  RESISTOR_0201  [0201]
R34182  10K  RESISTOR_0201  [0201]
R34183  10K  RESISTOR_0201  [0201]
R34184  10K  RESISTOR_0201  [0201]
R34185  10K  RESISTOR_0201  [0201]
R34186  10K  RESISTOR_0201  [0201]
R34187  10K  RESISTOR_0201  [0201]
R34188  10K  RESISTOR_0201  [0201]
R34189  10K  RESISTOR_0201  [0201]
R34190  10K  RESISTOR_0201  [0201]
R34191  10K  RESISTOR_0201  [0201]
R34192  10K  RESISTOR_0201  [0201]
R34193  10K  RESISTOR_0201  [0201]
R34194  10K  RESISTOR_0201  [0201]
R34195  10K  RESISTOR_0201  [0201]
R34196  10K  RESISTOR_0201  [0201]
R34197  10K  RESISTOR_0201  [0201]
R34198  10K  RESISTOR_0201  [0201]
R34199  10K  RESISTOR_0201  [0201]
R34200  10K  RESISTOR_0201  [0201]
R34201  10K  RESISTOR_0201  [0201]
R34202  10K  RESISTOR_0201  [0201]
R34203  10K  RESISTOR_0201  [0201]
R34204  10K  RESISTOR_0201  [0201]
R34205  10K  RESISTOR_0201  [0201]
R34206  10K  RESISTOR_0201  [0201]
R34207  10K  RESISTOR_0201  [0201]
R34208  10K  RESISTOR_0201  [0201]
R34209  10K  RESISTOR_0201  [0201]
R34210  10K  RESISTOR_0201  [0201]
R34211  10K  RESISTOR_0201  [0201]
R34212  10K  RESISTOR_0201  [0201]
R34213  10K  RESISTOR_0201  [0201]
R34214  10K  RESISTOR_0201  [0201]
R34215  10K  RESISTOR_0201  [0201]
R34216  10K  RESISTOR_0201  [0201]
R34217  10K  RESISTOR_0201  [0201]
R34218  10K  RESISTOR_0201  [0201]
R34219  10K  RESISTOR_0201  [0201]
R34220  10K  RESISTOR_0201  [0201]
R34221  10K  RESISTOR_0201  [0201]
R34222  10K  RESISTOR_0201  [0201]
R34223  10K  RESISTOR_0201  [0201]
R34224  10K  RESISTOR_0201  [0201]
R34225  10K  RESISTOR_0201  [0201]
R34226  10K  RESISTOR_0201  [0201]
R34227  10K  RESISTOR_0201  [0201]
R34228  10K  RESISTOR_0201  [0201]
R34229  10K  RESISTOR_0201  [0201]
R34230  10K  RESISTOR_0201  [0201]
R34231  10K  RESISTOR_0201  [0201]
R34232  10K  RESISTOR_0201  [0201]
R34233  10K  RESISTOR_0201  [0201]
R34234  10K  RESISTOR_0201  [0201]
R34235  10K  RESISTOR_0201  [0201]
R34236  10K  RESISTOR_0201  [0201]
R34237  10K  RESISTOR_0201  [0201]
R34238  10K  RESISTOR_0201  [0201]
R34239  10K  RESISTOR_0201  [0201]
R34240  10K  RESISTOR_0201  [0201]
R34241  10K  RESISTOR_0201  [0201]
R34242  10K  RESISTOR_0201  [0201]
R34243  10K  RESISTOR_0201  [0201]
R34244  10K  RESISTOR_0201  [0201]
R34245  10K  RESISTOR_0201  [0201]
R34246  10K  RESISTOR_0201  [0201]
R34247  10K  RESISTOR_0201  [0201]
R34248  10K  RESISTOR_0201  [0201]
R34249  10K  RESISTOR_0201  [0201]
R34250  10K  RESISTOR_0201  [0201]
R34251  10K  RESISTOR_0201  [0201]
R34252  10K  RESISTOR_0201  [0201]
R34253  10K  RESISTOR_0201  [0201]
R34254  10K  RESISTOR_0201  [0201]
R34255  10K  RESISTOR_0201  [0201]
R34256  10K  RESISTOR_0201  [0201]
R34257  10K  RESISTOR_0201  [0201]
R34258  10K  RESISTOR_0201  [0201]
R34259  10K  RESISTOR_0201  [0201]
R34260  10K  RESISTOR_0201  [0201]
R34261  10K  RESISTOR_0201  [0201]
R34262  10K  RESISTOR_0201  [0201]
R34263  10K  RESISTOR_0201  [0201]
R34264  10K  RESISTOR_0201  [0201]
R34265  10K  RESISTOR_0201  [0201]
R34266  10K  RESISTOR_0201  [0201]
R34267  10K  RESISTOR_0201  [0201]
R34268  10K  RESISTOR_0201  [0201]
R34269  10K  RESISTOR_0201  [0201]
R34270  10K  RESISTOR_0201  [0201]
R34271  10K  RESISTOR_0201  [0201]
R34272  10K  RESISTOR_0201  [0201]
R34273  10K  RESISTOR_0201  [0201]
R34274  10K  RESISTOR_0201  [0201]
R34275  10K  RESISTOR_0201  [0201]
R34276  10K  RESISTOR_0201  [0201]
R34277  10K  RESISTOR_0201  [0201]
R34278  10K  RESISTOR_0201  [0201]
R34279  10K  RESISTOR_0201  [0201]
R34280  10K  RESISTOR_0201  [0201]
R34281  10K  RESISTOR_0201  [0201]
R34282  10K  RESISTOR_0201  [0201]
R34283  10K  RESISTOR_0201  [0201]
R34284  10K  RESISTOR_0201  [0201]
R34285  10K  RESISTOR_0201  [0201]
R34286  10K  RESISTOR_0201  [0201]
R34287  10K  RESISTOR_0201  [0201]
R34288  10K  RESISTOR_0201  [0201]
R34289  10K  RESISTOR_0201  [0201]
R34290  10K  RESISTOR_0201  [0201]
R34291  10K  RESISTOR_0201  [0201]
R34292  10K  RESISTOR_0201  [0201]
R34293  10K  RESISTOR_0201  [0201]
R34294  10K  RESISTOR_0201  [0201]
R34295  10K  RESISTOR_0201  [0201]
R34296  10K  RESISTOR_0201  [0201]
R34297  10K  RESISTOR_0201  [0201]
R34298  10K  RESISTOR_0201  [0201]
R34299  10K  RESISTOR_0201  [0201]
R34300  10K  RESISTOR_0201  [0201]
R34301  10K  RESISTOR_0201  [0201]
R34302  10K  RESISTOR_0201  [0201]
R34303  10K  RESISTOR_0201  [0201]
R34304  10K  RESISTOR_0201  [0201]
R34305  10K  RESISTOR_0201  [0201]
R34306  10K  RESISTOR_0201  [0201]
R34307  10K  RESISTOR_0201  [0201]
R34308  10K  RESISTOR_0201  [0201]
R34309  10K  RESISTOR_0201  [0201]
R34310  10K  RESISTOR_0201  [0201]
R34311  10K  RESISTOR_0201  [0201]
R34312  10K  RESISTOR_0201  [0201]
R34313  10K  RESISTOR_0201  [0201]
R34314  10K  RESISTOR_0201  [0201]
R34315  10K  RESISTOR_0201  [0201]
R34316  10K  RESISTOR_0201  [0201]
R34317  10K  RESISTOR_0201  [0201]
R34318  10K  RESISTOR_0201  [0201]
R34319  10K  RESISTOR_0201  [0201]
R34320  10K  RESISTOR_0201  [0201]
R34321  10K  RESISTOR_0201  [0201]
R34322  10K  RESISTOR_0201  [0201]
R34323  10K  RESISTOR_0201  [0201]
R34324  10K  RESISTOR_0201  [0201]
R34325  10K  RESISTOR_0201  [0201]
R34326  10K  RESISTOR_0201  [0201]
R34327  10K  RESISTOR_0201  [0201]
R34328  10K  RESISTOR_0201  [0201]
R34329  10K  RESISTOR_0201  [0201]
R34330  10K  RESISTOR_0201  [0201]
R34331  10K  RESISTOR_0201  [0201]
R34332  10K  RESISTOR_0201  [0201]
R34333  10K  RESISTOR_0201  [0201]
R34334  10K  RESISTOR_0201  [0201]
R34335  10K  RESISTOR_0201  [0201]
R34336  10K  RESISTOR_0201  [0201]
R34337  10K  RESISTOR_0201  [0201]
R34338  10K  RESISTOR_0201  [0201]
R34339  10K  RESISTOR_0201  [0201]
R34340  10K  RESISTOR_0201  [0201]
R34341  10K  RESISTOR_0201  [0201]
R34342  10K  RESISTOR_0201  [0201]
R34343  10K  RESISTOR_0201  [0201]
R34344  10K  RESISTOR_0201  [0201]
R34345  10K  RESISTOR_0201  [0201]
R34346  10K  RESISTOR_0201  [0201]
R34347  10K  RESISTOR_0201  [0201]
R34348  10K  RESISTOR_0201  [0201]
R34349  10K  RESISTOR_0201  [0201]
R34350  10K  RESISTOR_0201  [0201]
R34351  10K  RESISTOR_0201  [0201]
R34352  10K  RESISTOR_0201  [0201]
R34353  10K  RESISTOR_0201  [0201]
R34354  10K  RESISTOR_0201  [0201]
R34355  10K  RESISTOR_0201  [0201]
R34356  10K  RESISTOR_0201  [0201]
R34357  10K  RESISTOR_0201  [0201]
R34358  10K  RESISTOR_0201  [0201]
R34359  10K  RESISTOR_0201  [0201]
R34360  10K  RESISTOR_0201  [0201]
R34361  10K  RESISTOR_0201  [0201]
R34362  10K  RESISTOR_0201  [0201]
R34363  10K  RESISTOR_0201  [0201]
R34364  10K  RESISTOR_0201  [0201]
R34365  10K  RESISTOR_0201  [0201]
R34366  10K  RESISTOR_0201  [0201]
R34367  10K  RESISTOR_0201  [0201]
R34368  10K  RESISTOR_0201  [0201]
R34369  10K  RESISTOR_0201  [0201]
R34370  10K  RESISTOR_0201  [0201]
R34371  10K  RESISTOR_0201  [0201]
R34372  10K  RESISTOR_0201  [0201]
R34373  10K  RESISTOR_0201  [0201]
R34374  10K  RESISTOR_0201  [0201]
R34375  10K  RESISTOR_0201  [0201]
R34376  10K  RESISTOR_0201  [0201]
R34377  10K  RESISTOR_0201  [0201]